# Altium schematic sheet SOC_PL_GTX.SchDoc: Title
size 420 x 297 mm; Author: G.Kasprowicz; CompanyName: WUT ISE; DrawnBy: G.Kasprowicz; Organization: WUT ISE; Address1: PW ISE; Address2: Nowowiejska 15/19 00-665 Warsaw; Address3: gkasprow@gmail.com; DocumentNumber: 17; Revision: 2; SheetNumber: 17; SheetTotal: 40; ModifiedBy: -; CheckedDate: -; Title2: Title 2; DivGrp: WUT ISE; Designer: G.Kasprowicz; ModifiedDate: -; ProjectName: Sensor Box
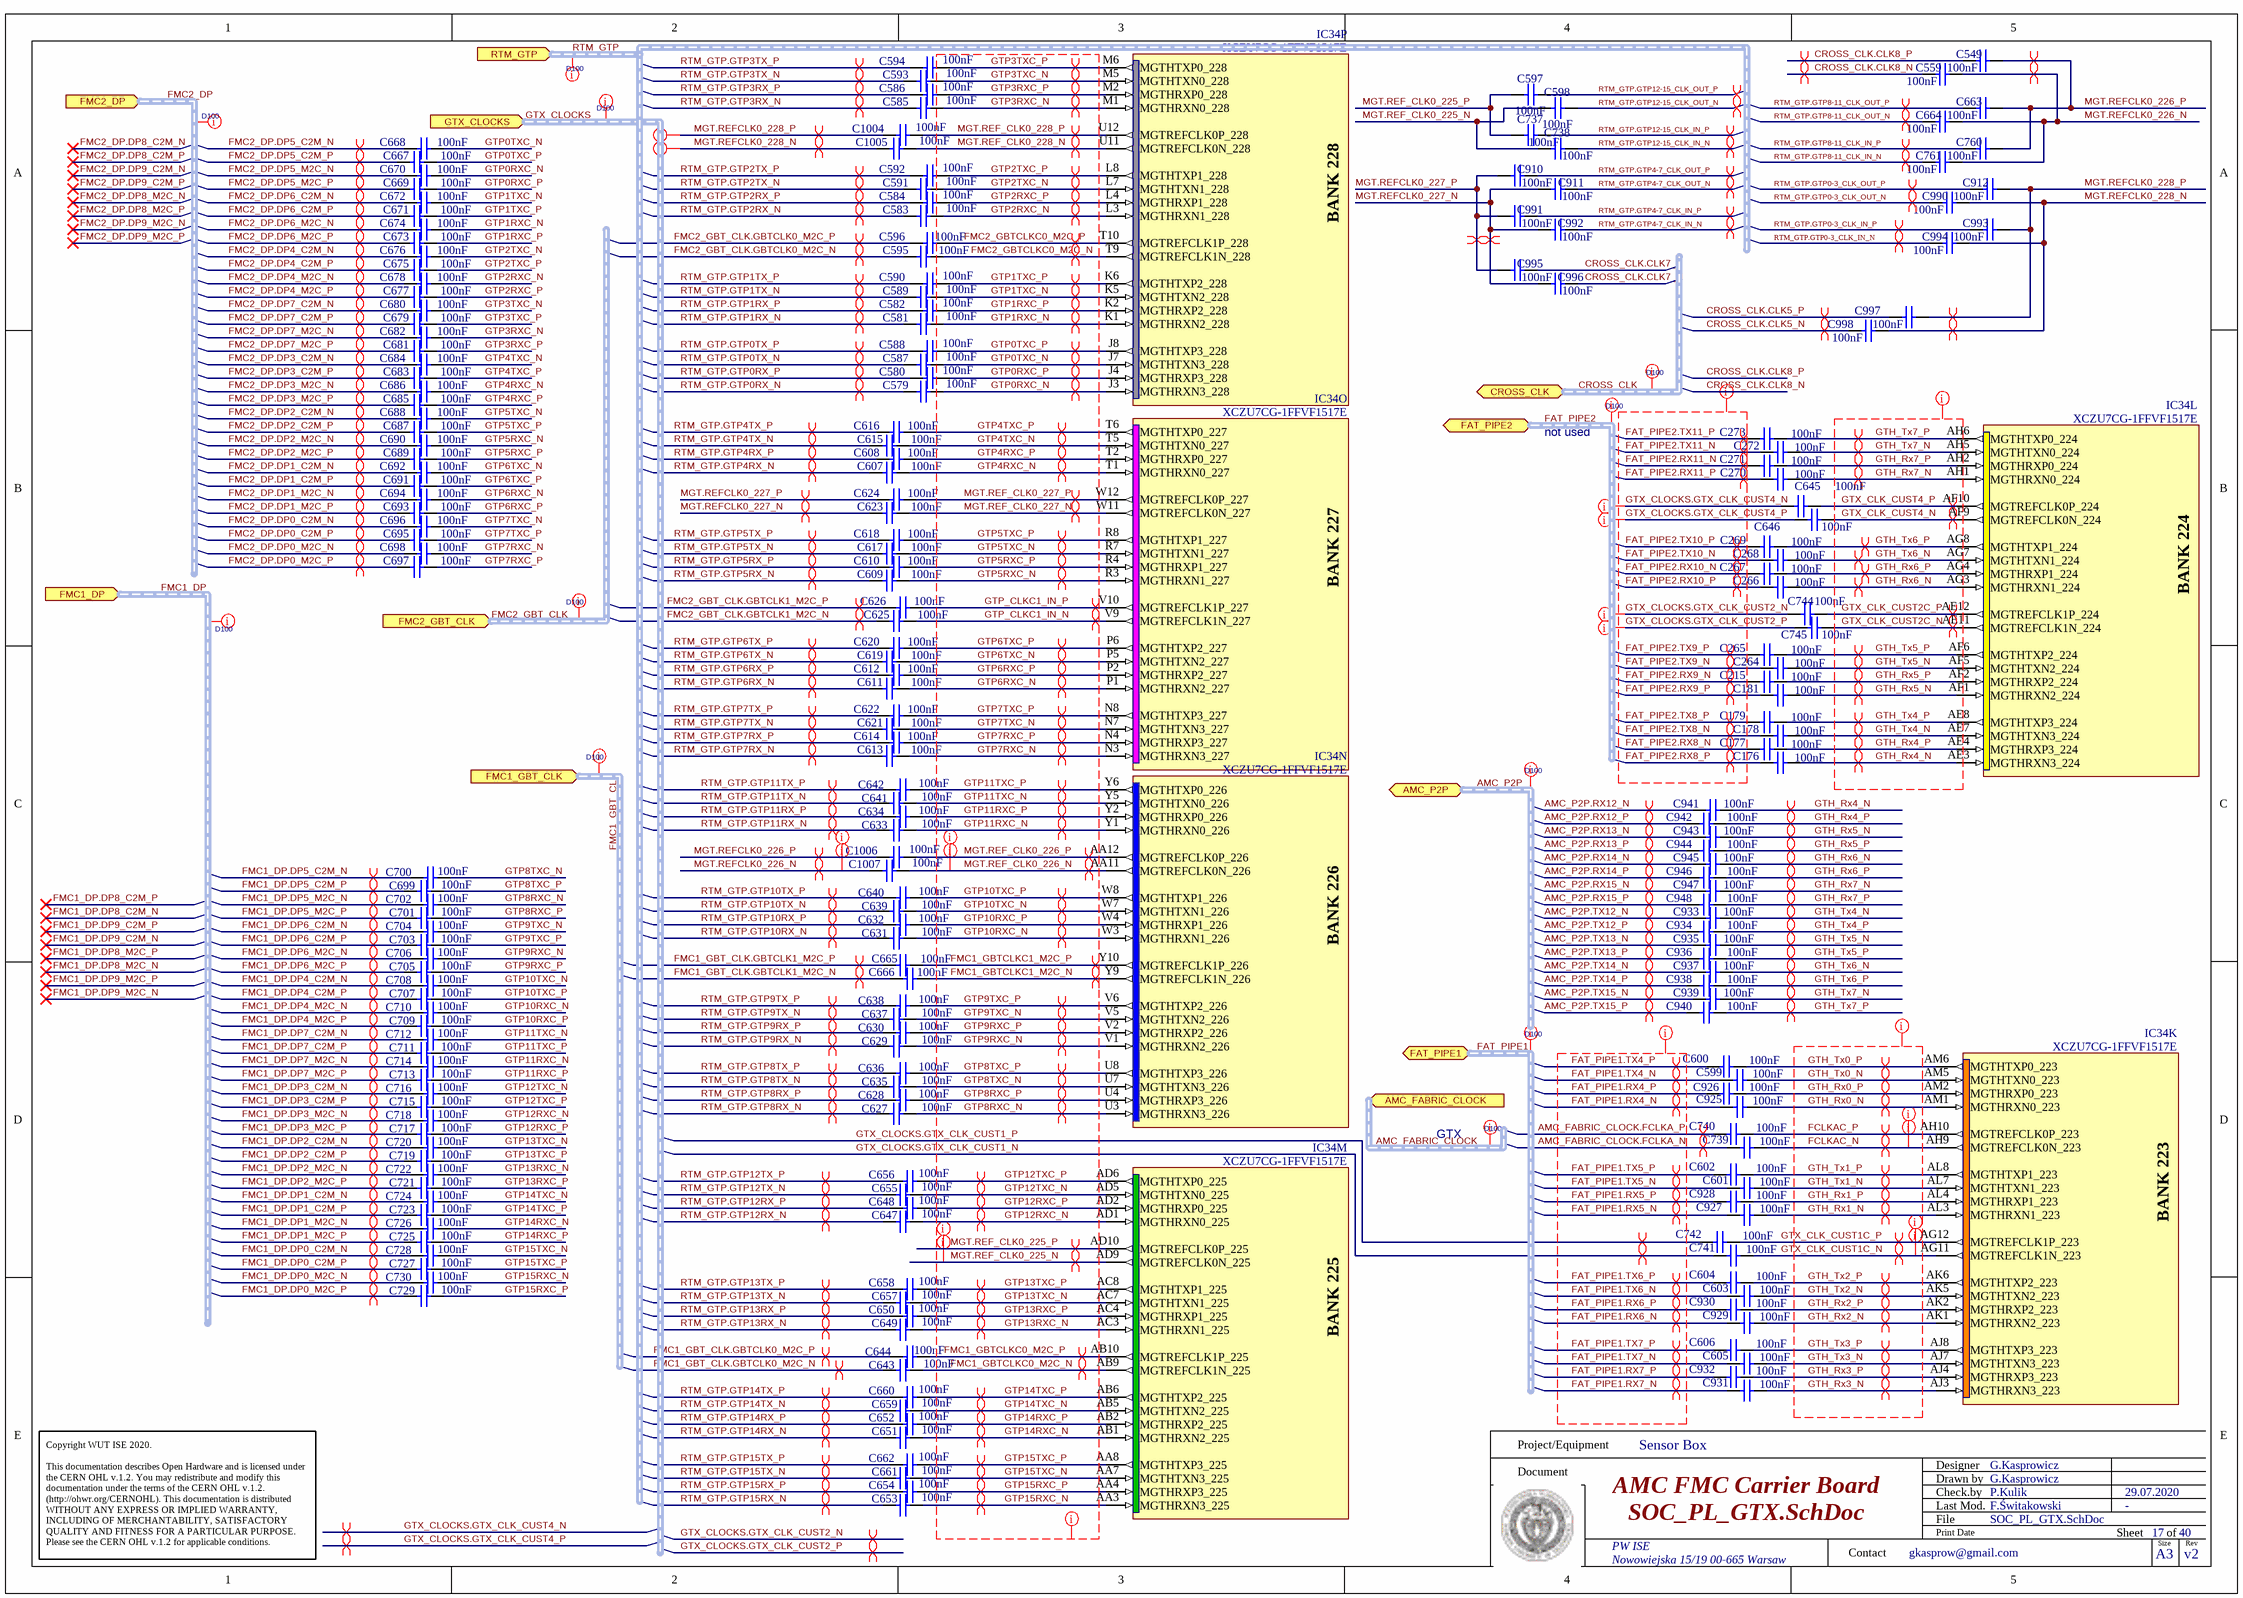
[diagram p0: SOC_PL_GTX.SchDoc]

## Parts
C176  100nF  [CAPC0603X33N]
C177  100nF  [CAPC0603X33N]
C178  100nF  [CAPC0603X33N]
C179  100nF  [CAPC0603X33N]
C181  100nF  [CAPC0603X33N]
C215  100nF  [CAPC0603X33N]
C264  100nF  [CAPC0603X33N]
C265  100nF  [CAPC0603X33N]
C266  100nF  [CAPC0603X33N]
C267  100nF  [CAPC0603X33N]
C268  100nF  [CAPC0603X33N]
C269  100nF  [CAPC0603X33N]
C270  100nF  [CAPC0603X33N]
C271  100nF  [CAPC0603X33N]
C272  100nF  [CAPC0603X33N]
C273  100nF  [CAPC0603X33N]
C549  100nF  [CAPC0603X33N]
C559  100nF  [CAPC0603X33N]
C579  100nF  [CAPC0603X33N]
C580  100nF  [CAPC0603X33N]
C581  100nF  [CAPC0603X33N]
C582  100nF  [CAPC0603X33N]
C583  100nF  [CAPC0603X33N]
C584  100nF  [CAPC0603X33N]
C585  100nF  [CAPC0603X33N]
C586  100nF  [CAPC0603X33N]
C587  100nF  [CAPC0603X33N]
C588  100nF  [CAPC0603X33N]
C589  100nF  [CAPC0603X33N]
C590  100nF  [CAPC0603X33N]
C591  100nF  [CAPC0603X33N]
C592  100nF  [CAPC0603X33N]
C593  100nF  [CAPC0603X33N]
C594  100nF  [CAPC0603X33N]
C595  100nF  [CAPC0603X33N]
C596  100nF  [CAPC0603X33N]
C597  100nF  [CAPC0603X33N]
C598  100nF  [CAPC0603X33N]
C599  100nF  [CAPC0603X33N]
C600  100nF  [CAPC0603X33N]
C601  100nF  [CAPC0603X33N]
C602  100nF  [CAPC0603X33N]
C603  100nF  [CAPC0603X33N]
C604  100nF  [CAPC0603X33N]
C605  100nF  [CAPC0603X33N]
C606  100nF  [CAPC0603X33N]
C607  100nF  [CAPC0603X33N]
C608  100nF  [CAPC0603X33N]
C609  100nF  [CAPC0603X33N]
C610  100nF  [CAPC0603X33N]
C611  100nF  [CAPC0603X33N]
C612  100nF  [CAPC0603X33N]
C613  100nF  [CAPC0603X33N]
C614  100nF  [CAPC0603X33N]
C615  100nF  [CAPC0603X33N]
C616  100nF  [CAPC0603X33N]
C617  100nF  [CAPC0603X33N]
C618  100nF  [CAPC0603X33N]
C619  100nF  [CAPC0603X33N]
C620  100nF  [CAPC0603X33N]
C621  100nF  [CAPC0603X33N]
C622  100nF  [CAPC0603X33N]
C623  100nF  [CAPC0603X33N]
C624  100nF  [CAPC0603X33N]
C625  100nF  [CAPC0603X33N]
C626  100nF  [CAPC0603X33N]
C627  100nF  [CAPC0603X33N]
C628  100nF  [CAPC0603X33N]
C629  100nF  [CAPC0603X33N]
C630  100nF  [CAPC0603X33N]
C631  100nF  [CAPC0603X33N]
C632  100nF  [CAPC0603X33N]
C633  100nF  [CAPC0603X33N]
C634  100nF  [CAPC0603X33N]
C635  100nF  [CAPC0603X33N]
C636  100nF  [CAPC0603X33N]
C637  100nF  [CAPC0603X33N]
C638  100nF  [CAPC0603X33N]
C639  100nF  [CAPC0603X33N]
C640  100nF  [CAPC0603X33N]
C641  100nF  [CAPC0603X33N]
C642  100nF  [CAPC0603X33N]
C643  100nF  [CAPC0603X33N]
C644  100nF  [CAPC0603X33N]
C645  100nF  [CAPC0603X33N]
C646  100nF  [CAPC0603X33N]
C647  100nF  [CAPC0603X33N]
C648  100nF  [CAPC0603X33N]
C649  100nF  [CAPC0603X33N]
C650  100nF  [CAPC0603X33N]
C651  100nF  [CAPC0603X33N]
C652  100nF  [CAPC0603X33N]
C653  100nF  [CAPC0603X33N]
C654  100nF  [CAPC0603X33N]
C655  100nF  [CAPC0603X33N]
C656  100nF  [CAPC0603X33N]
C657  100nF  [CAPC0603X33N]
C658  100nF  [CAPC0603X33N]
C659  100nF  [CAPC0603X33N]
C660  100nF  [CAPC0603X33N]
C661  100nF  [CAPC0603X33N]
C662  100nF  [CAPC0603X33N]
C663  100nF  [CAPC0603X33N]
C664  100nF  [CAPC0603X33N]
C665  100nF  [CAPC0603X33N]
C666  100nF  [CAPC0603X33N]
C667  100nF  [CAPC0603X33N]
C668  100nF  [CAPC0603X33N]
C669  100nF  [CAPC0603X33N]
C670  100nF  [CAPC0603X33N]
C671  100nF  [CAPC0603X33N]
C672  100nF  [CAPC0603X33N]
C673  100nF  [CAPC0603X33N]
C674  100nF  [CAPC0603X33N]
C675  100nF  [CAPC0603X33N]
C676  100nF  [CAPC0603X33N]
C677  100nF  [CAPC0603X33N]
C678  100nF  [CAPC0603X33N]
C679  100nF  [CAPC0603X33N]
C680  100nF  [CAPC0603X33N]
C681  100nF  [CAPC0603X33N]
C682  100nF  [CAPC0603X33N]
C683  100nF  [CAPC0603X33N]
C684  100nF  [CAPC0603X33N]
C685  100nF  [CAPC0603X33N]
C686  100nF  [CAPC0603X33N]
C687  100nF  [CAPC0603X33N]
C688  100nF  [CAPC0603X33N]
C689  100nF  [CAPC0603X33N]
C690  100nF  [CAPC0603X33N]
C691  100nF  [CAPC0603X33N]
C692  100nF  [CAPC0603X33N]
C693  100nF  [CAPC0603X33N]
C694  100nF  [CAPC0603X33N]
C695  100nF  [CAPC0603X33N]
C696  100nF  [CAPC0603X33N]
C697  100nF  [CAPC0603X33N]
C698  100nF  [CAPC0603X33N]
C699  100nF  [CAPC0603X33N]
C700  100nF  [CAPC0603X33N]
C701  100nF  [CAPC0603X33N]
C702  100nF  [CAPC0603X33N]
C703  100nF  [CAPC0603X33N]
C704  100nF  [CAPC0603X33N]
C705  100nF  [CAPC0603X33N]
C706  100nF  [CAPC0603X33N]
C707  100nF  [CAPC0603X33N]
C708  100nF  [CAPC0603X33N]
C709  100nF  [CAPC0603X33N]
C710  100nF  [CAPC0603X33N]
C711  100nF  [CAPC0603X33N]
C712  100nF  [CAPC0603X33N]
C713  100nF  [CAPC0603X33N]
C714  100nF  [CAPC0603X33N]
C715  100nF  [CAPC0603X33N]
C716  100nF  [CAPC0603X33N]
C717  100nF  [CAPC0603X33N]
C718  100nF  [CAPC0603X33N]
C719  100nF  [CAPC0603X33N]
C720  100nF  [CAPC0603X33N]
C721  100nF  [CAPC0603X33N]
C722  100nF  [CAPC0603X33N]
C723  100nF  [CAPC0603X33N]
C724  100nF  [CAPC0603X33N]
C725  100nF  [CAPC0603X33N]
C726  100nF  [CAPC0603X33N]
C727  100nF  [CAPC0603X33N]
C728  100nF  [CAPC0603X33N]
C729  100nF  [CAPC0603X33N]
C730  100nF  [CAPC0603X33N]
C737  100nF  [CAPC0603X33N]
C738  100nF  [CAPC0603X33N]
C739  100nF  [CAPC0603X33N]
C740  100nF  [CAPC0603X33N]
C741  100nF  [CAPC0603X33N]
C742  100nF  [CAPC0603X33N]
C744  100nF  [CAPC0603X33N]
C745  100nF  [CAPC0603X33N]
C760  100nF  [CAPC0603X33N]
C761  100nF  [CAPC0603X33N]
C910  100nF  [CAPC0603X33N]
C911  100nF  [CAPC0603X33N]
C912  100nF  [CAPC0603X33N]
C925  100nF  [CAPC0603X33N]
C926  100nF  [CAPC0603X33N]
C927  100nF  [CAPC0603X33N]
C928  100nF  [CAPC0603X33N]
C929  100nF  [CAPC0603X33N]
C930  100nF  [CAPC0603X33N]
C931  100nF  [CAPC0603X33N]
C932  100nF  [CAPC0603X33N]
C933  100nF  [CAPC0603X33N]
C934  100nF  [CAPC0603X33N]
C935  100nF  [CAPC0603X33N]
C936  100nF  [CAPC0603X33N]
C937  100nF  [CAPC0603X33N]
C938  100nF  [CAPC0603X33N]
C939  100nF  [CAPC0603X33N]
C940  100nF  [CAPC0603X33N]
C941  100nF  [CAPC0603X33N]
C942  100nF  [CAPC0603X33N]
C943  100nF  [CAPC0603X33N]
C944  100nF  [CAPC0603X33N]
C945  100nF  [CAPC0603X33N]
C946  100nF  [CAPC0603X33N]
C947  100nF  [CAPC0603X33N]
C948  100nF  [CAPC0603X33N]
C990  100nF  [CAPC0603X33N]
C991  100nF  [CAPC0603X33N]
C992  100nF  [CAPC0603X33N]
C993  100nF  [CAPC0603X33N]
C994  100nF  [CAPC0603X33N]
C995  100nF  [CAPC0603X33N]
C996  100nF  [CAPC0603X33N]
C997  100nF  [CAPC0603X33N]
C998  100nF  [CAPC0603X33N]
C1004  100nF  [CAPC0603X33N]
C1005  100nF  [CAPC0603X33N]
C1006  100nF  [CAPC0603X33N]
C1007  100nF  [CAPC0603X33N]
IC34  XCZU7CG-1FFVF1517E  [BGA1517C100P39X39_4000X4000X351]  (parts K,L,M,N,O,P of 28)

## Ports
AMC_FABRIC_CLOCK (in, harness AMC_FABRIC_CLOCK), AMC_P2P (bidir, harness AMC_P2P), CROSS_CLK (bidir, harness CROSS_CLK), FAT_PIPE1 (bidir, harness FAT_PIPE1), FAT_PIPE2 (bidir, harness FAT_PIPE2), FMC1_DP (in, harness FMC1_DP), FMC1_GBT_CLK (in, harness FMC1_GBT_CLK), FMC2_DP (in, harness FMC2_DP), FMC2_GBT_CLK (in, harness FMC2_GBT_CLK), GTX_CLOCKS (in, harness GTX_CLOCKS), RTM_GTP (in, harness RTM_GTP)

## Nets
AMC_FABRIC_CLOCK.FCLKA_N: C739.1
AMC_FABRIC_CLOCK.FCLKA_P: C740.1
AMC_P2P.RX12_N: C941.1
AMC_P2P.RX12_P: C942.1
AMC_P2P.RX13_N: C943.1
AMC_P2P.RX13_P: C944.1
AMC_P2P.RX14_N: C945.1
AMC_P2P.RX14_P: C946.1
AMC_P2P.RX15_N: C947.1
AMC_P2P.RX15_P: C948.1
AMC_P2P.TX12_N: C933.1
AMC_P2P.TX12_P: C934.1
AMC_P2P.TX13_N: C935.1
AMC_P2P.TX13_P: C936.1
AMC_P2P.TX14_N: C937.1
AMC_P2P.TX14_P: C938.1
AMC_P2P.TX15_N: C939.1
AMC_P2P.TX15_P: C940.1
CROSS_CLK.CLK5_N: C998.2
CROSS_CLK.CLK5_P: C997.2
CROSS_CLK.CLK7_N: C996.2
CROSS_CLK.CLK7_P: C995.2
CROSS_CLK.CLK8_N: C559.2
CROSS_CLK.CLK8_P: C549.2
FAT_PIPE1.RX4_N: C925.1
FAT_PIPE1.RX4_P: C926.1
FAT_PIPE1.RX5_N: C927.1
FAT_PIPE1.RX5_P: C928.1
FAT_PIPE1.RX6_N: C929.1
FAT_PIPE1.RX6_P: C930.1
FAT_PIPE1.RX7_N: C931.1
FAT_PIPE1.RX7_P: C932.1
FAT_PIPE1.TX4_N: C599.1
FAT_PIPE1.TX4_P: C600.1
FAT_PIPE1.TX5_N: C601.1
FAT_PIPE1.TX5_P: C602.1
FAT_PIPE1.TX6_N: C603.1
FAT_PIPE1.TX6_P: C604.1
FAT_PIPE1.TX7_N: C605.1
FAT_PIPE1.TX7_P: C606.1
FAT_PIPE2.RX8_N: C177.1
FAT_PIPE2.RX8_P: C176.1
FAT_PIPE2.RX9_N: C215.1
FAT_PIPE2.RX9_P: C181.1
FAT_PIPE2.RX10_N: C267.1
FAT_PIPE2.RX10_P: C266.1
FAT_PIPE2.RX11_N: C271.1
FAT_PIPE2.RX11_P: C270.1
FAT_PIPE2.TX8_N: C178.1
FAT_PIPE2.TX8_P: C179.1
FAT_PIPE2.TX9_N: C264.1
FAT_PIPE2.TX9_P: C265.1
FAT_PIPE2.TX10_N: C268.1
FAT_PIPE2.TX10_P: C269.1
FAT_PIPE2.TX11_N: C272.1
FAT_PIPE2.TX11_P: C273.1
FCLKAC_N: C739.2 IC34.AH9(MGTREFCLK0N_223)
FCLKAC_P: C740.2 IC34.AH10(MGTREFCLK0P_223)
FMC1_DP.DP0_C2M_N: C728.1
FMC1_DP.DP0_C2M_P: C727.1
FMC1_DP.DP0_M2C_N: C730.1
FMC1_DP.DP0_M2C_P: C729.1
FMC1_DP.DP1_C2M_N: C724.1
FMC1_DP.DP1_C2M_P: C723.1
FMC1_DP.DP1_M2C_N: C726.1
FMC1_DP.DP1_M2C_P: C725.1
FMC1_DP.DP2_C2M_N: C720.1
FMC1_DP.DP2_C2M_P: C719.1
FMC1_DP.DP2_M2C_N: C722.1
FMC1_DP.DP2_M2C_P: C721.1
FMC1_DP.DP3_C2M_N: C716.1
FMC1_DP.DP3_C2M_P: C715.1
FMC1_DP.DP3_M2C_N: C718.1
FMC1_DP.DP3_M2C_P: C717.1
FMC1_DP.DP4_C2M_N: C708.1
FMC1_DP.DP4_C2M_P: C707.1
FMC1_DP.DP4_M2C_N: C710.1
FMC1_DP.DP4_M2C_P: C709.1
FMC1_DP.DP5_C2M_N: C700.1
FMC1_DP.DP5_C2M_P: C699.1
FMC1_DP.DP5_M2C_N: C702.1
FMC1_DP.DP5_M2C_P: C701.1
FMC1_DP.DP6_C2M_N: C704.1
FMC1_DP.DP6_C2M_P: C703.1
FMC1_DP.DP6_M2C_N: C706.1
FMC1_DP.DP6_M2C_P: C705.1
FMC1_DP.DP7_C2M_N: C712.1
FMC1_DP.DP7_C2M_P: C711.1
FMC1_DP.DP7_M2C_N: C714.1
FMC1_DP.DP7_M2C_P: C713.1
FMC1_GBT_CLK.GBTCLK0_M2C_N: C643.1
FMC1_GBT_CLK.GBTCLK0_M2C_P: C644.1
FMC1_GBT_CLK.GBTCLK1_M2C_N: C666.1
FMC1_GBT_CLK.GBTCLK1_M2C_P: C665.1
FMC1_GBTCLKC0_M2C_N: C643.2 IC34.AB9(MGTREFCLK1N_225)
FMC1_GBTCLKC0_M2C_P: C644.2 IC34.AB10(MGTREFCLK1P_225)
FMC1_GBTCLKC1_M2C_N: C666.2 IC34.Y9(MGTREFCLK1N_226)
FMC1_GBTCLKC1_M2C_P: C665.2 IC34.Y10(MGTREFCLK1P_226)
FMC2_DP.DP0_C2M_N: C696.1
FMC2_DP.DP0_C2M_P: C695.1
FMC2_DP.DP0_M2C_N: C698.1
FMC2_DP.DP0_M2C_P: C697.1
FMC2_DP.DP1_C2M_N: C692.1
FMC2_DP.DP1_C2M_P: C691.1
FMC2_DP.DP1_M2C_N: C694.1
FMC2_DP.DP1_M2C_P: C693.1
FMC2_DP.DP2_C2M_N: C688.1
FMC2_DP.DP2_C2M_P: C687.1
FMC2_DP.DP2_M2C_N: C690.1
FMC2_DP.DP2_M2C_P: C689.1
FMC2_DP.DP3_C2M_N: C684.1
FMC2_DP.DP3_C2M_P: C683.1
FMC2_DP.DP3_M2C_N: C686.1
FMC2_DP.DP3_M2C_P: C685.1
FMC2_DP.DP4_C2M_N: C676.1
FMC2_DP.DP4_C2M_P: C675.1
FMC2_DP.DP4_M2C_N: C678.1
FMC2_DP.DP4_M2C_P: C677.1
FMC2_DP.DP5_C2M_N: C668.1
FMC2_DP.DP5_C2M_P: C667.1
FMC2_DP.DP5_M2C_N: C670.1
FMC2_DP.DP5_M2C_P: C669.1
FMC2_DP.DP6_C2M_N: C672.1
FMC2_DP.DP6_C2M_P: C671.1
FMC2_DP.DP6_M2C_N: C674.1
FMC2_DP.DP6_M2C_P: C673.1
FMC2_DP.DP7_C2M_N: C680.1
FMC2_DP.DP7_C2M_P: C679.1
FMC2_DP.DP7_M2C_N: C682.1
FMC2_DP.DP7_M2C_P: C681.1
FMC2_GBT_CLK.GBTCLK0_M2C_N: C595.1
FMC2_GBT_CLK.GBTCLK0_M2C_P: C596.1
FMC2_GBT_CLK.GBTCLK1_M2C_N: C625.1
FMC2_GBT_CLK.GBTCLK1_M2C_P: C626.1
FMC2_GBTCLKC0_M2C_N: C595.2 IC34.T9(MGTREFCLK1N_228)
FMC2_GBTCLKC0_M2C_P: C596.2 IC34.T10(MGTREFCLK1P_228)
GTH_Rx0_N: C925.2 IC34.AM1(MGTHRXN0_223)
GTH_Rx0_P: C926.2 IC34.AM2(MGTHRXP0_223)
GTH_Rx1_N: C927.2 IC34.AL3(MGTHRXN1_223)
GTH_Rx1_P: C928.2 IC34.AL4(MGTHRXP1_223)
GTH_Rx2_N: C929.2 IC34.AK1(MGTHRXN2_223)
GTH_Rx2_P: C930.2 IC34.AK2(MGTHRXP2_223)
GTH_Rx3_N: C931.2 IC34.AJ3(MGTHRXN3_223)
GTH_Rx3_P: C932.2 IC34.AJ4(MGTHRXP3_223)
GTH_Rx4_N: C176.2 C941.2 IC34.AE3(MGTHRXN3_224)
GTH_Rx4_P: C177.2 C942.2 IC34.AE4(MGTHRXP3_224)
GTH_Rx5_N: C181.2 C943.2 IC34.AF1(MGTHRXN2_224)
GTH_Rx5_P: C215.2 C944.2 IC34.AF2(MGTHRXP2_224)
GTH_Rx6_N: C266.2 C945.2 IC34.AG3(MGTHRXN1_224)
GTH_Rx6_P: C267.2 C946.2 IC34.AG4(MGTHRXP1_224)
GTH_Rx7_N: C270.2 C947.2 IC34.AH1(MGTHRXN0_224)
GTH_Rx7_P: C271.2 C948.2 IC34.AH2(MGTHRXP0_224)
GTH_Tx0_N: C599.2 IC34.AM5(MGTHTXN0_223)
GTH_Tx0_P: C600.2 IC34.AM6(MGTHTXP0_223)
GTH_Tx1_N: C601.2 IC34.AL7(MGTHTXN1_223)
GTH_Tx1_P: C602.2 IC34.AL8(MGTHTXP1_223)
GTH_Tx2_N: C603.2 IC34.AK5(MGTHTXN2_223)
GTH_Tx2_P: C604.2 IC34.AK6(MGTHTXP2_223)
GTH_Tx3_N: C605.2 IC34.AJ7(MGTHTXN3_223)
GTH_Tx3_P: C606.2 IC34.AJ8(MGTHTXP3_223)
GTH_Tx4_N: C178.2 C933.2 IC34.AE7(MGTHTXN3_224)
GTH_Tx4_P: C179.2 C934.2 IC34.AE8(MGTHTXP3_224)
GTH_Tx5_N: C264.2 C935.2 IC34.AF5(MGTHTXN2_224)
GTH_Tx5_P: C265.2 C936.2 IC34.AF6(MGTHTXP2_224)
GTH_Tx6_N: C268.2 C937.2 IC34.AG7(MGTHTXN1_224)
GTH_Tx6_P: C269.2 C938.2 IC34.AG8(MGTHTXP1_224)
GTH_Tx7_N: C272.2 C939.2 IC34.AH5(MGTHTXN0_224)
GTH_Tx7_P: C273.2 C940.2 IC34.AH6(MGTHTXP0_224)
GTP0RXC_N: C579.2 C670.2 IC34.J3(MGTHRXN3_228)
GTP0RXC_P: C580.2 C669.2 IC34.J4(MGTHRXP3_228)
GTP0TXC_N: C587.2 C668.2 IC34.J7(MGTHTXN3_228)
GTP0TXC_P: C588.2 C667.2 IC34.J8(MGTHTXP3_228)
GTP1RXC_N: C581.2 C674.2 IC34.K1(MGTHRXN2_228)
GTP1RXC_P: C582.2 C673.2 IC34.K2(MGTHRXP2_228)
GTP1TXC_N: C589.2 C672.2 IC34.K5(MGTHTXN2_228)
GTP1TXC_P: C590.2 C671.2 IC34.K6(MGTHTXP2_228)
GTP2RXC_N: C583.2 C678.2 IC34.L3(MGTHRXN1_228)
GTP2RXC_P: C584.2 C677.2 IC34.L4(MGTHRXP1_228)
GTP2TXC_N: C591.2 C676.2 IC34.L7(MGTHTXN1_228)
GTP2TXC_P: C592.2 C675.2 IC34.L8(MGTHTXP1_228)
GTP3RXC_N: C585.2 C682.2 IC34.M1(MGTHRXN0_228)
GTP3RXC_P: C586.2 C681.2 IC34.M2(MGTHRXP0_228)
GTP3TXC_N: C593.2 C680.2 IC34.M5(MGTHTXN0_228)
GTP3TXC_P: C594.2 C679.2 IC34.M6(MGTHTXP0_228)
GTP4RXC_N: C607.2 C686.2 IC34.T1(MGTHRXN0_227)
GTP4RXC_P: C608.2 C685.2 IC34.T2(MGTHRXP0_227)
GTP4TXC_N: C615.2 C684.2 IC34.T5(MGTHTXN0_227)
GTP4TXC_P: C616.2 C683.2 IC34.T6(MGTHTXP0_227)
GTP5RXC_N: C609.2 C690.2 IC34.R3(MGTHRXN1_227)
GTP5RXC_P: C610.2 C689.2 IC34.R4(MGTHRXP1_227)
GTP5TXC_N: C617.2 C688.2 IC34.R7(MGTHTXN1_227)
GTP5TXC_P: C618.2 C687.2 IC34.R8(MGTHTXP1_227)
GTP6RXC_N: C611.2 C694.2 IC34.P1(MGTHRXN2_227)
GTP6RXC_P: C612.2 C693.2 IC34.P2(MGTHRXP2_227)
GTP6TXC_N: C619.2 C692.2 IC34.P5(MGTHTXN2_227)
GTP6TXC_P: C620.2 C691.2 IC34.P6(MGTHTXP2_227)
GTP7RXC_N: C613.2 C698.2 IC34.N3(MGTHRXN3_227)
GTP7RXC_P: C614.2 C697.2 IC34.N4(MGTHRXP3_227)
GTP7TXC_N: C621.2 C696.2 IC34.N7(MGTHTXN3_227)
GTP7TXC_P: C622.2 C695.2 IC34.N8(MGTHTXP3_227)
GTP8RXC_N: C627.2 C702.2 IC34.U3(MGTHRXN3_226)
GTP8RXC_P: C628.2 C701.2 IC34.U4(MGTHRXP3_226)
GTP8TXC_N: C635.2 C700.2 IC34.U7(MGTHTXN3_226)
GTP8TXC_P: C636.2 C699.2 IC34.U8(MGTHTXP3_226)
GTP9RXC_N: C629.2 C706.2 IC34.V1(MGTHRXN2_226)
GTP9RXC_P: C630.2 C705.2 IC34.V2(MGTHRXP2_226)
GTP9TXC_N: C637.2 C704.2 IC34.V5(MGTHTXN2_226)
GTP9TXC_P: C638.2 C703.2 IC34.V6(MGTHTXP2_226)
GTP10RXC_N: C631.2 C710.2 IC34.W3(MGTHRXN1_226)
GTP10RXC_P: C632.2 C709.2 IC34.W4(MGTHRXP1_226)
GTP10TXC_N: C639.2 C708.2 IC34.W7(MGTHTXN1_226)
GTP10TXC_P: C640.2 C707.2 IC34.W8(MGTHTXP1_226)
GTP11RXC_N: C633.2 C714.2 IC34.Y1(MGTHRXN0_226)
GTP11RXC_P: C634.2 C713.2 IC34.Y2(MGTHRXP0_226)
GTP11TXC_N: C641.2 C712.2 IC34.Y5(MGTHTXN0_226)
GTP11TXC_P: C642.2 C711.2 IC34.Y6(MGTHTXP0_226)
GTP12RXC_N: C647.2 C718.2 IC34.AD1(MGTHRXN0_225)
GTP12RXC_P: C648.2 C717.2 IC34.AD2(MGTHRXP0_225)
GTP12TXC_N: C655.2 C716.2 IC34.AD5(MGTHTXN0_225)
GTP12TXC_P: C656.2 C715.2 IC34.AD6(MGTHTXP0_225)
GTP13RXC_N: C649.2 C722.2 IC34.AC3(MGTHRXN1_225)
GTP13RXC_P: C650.2 C721.2 IC34.AC4(MGTHRXP1_225)
GTP13TXC_N: C657.2 C720.2 IC34.AC7(MGTHTXN1_225)
GTP13TXC_P: C658.2 C719.2 IC34.AC8(MGTHTXP1_225)
GTP14RXC_N: C651.2 C726.2 IC34.AB1(MGTHRXN2_225)
GTP14RXC_P: C652.2 C725.2 IC34.AB2(MGTHRXP2_225)
GTP14TXC_N: C659.2 C724.2 IC34.AB5(MGTHTXN2_225)
GTP14TXC_P: C660.2 C723.2 IC34.AB6(MGTHTXP2_225)
GTP15RXC_N: C653.2 C730.2 IC34.AA3(MGTHRXN3_225)
GTP15RXC_P: C654.2 C729.2 IC34.AA4(MGTHRXP3_225)
GTP15TXC_N: C661.2 C728.2 IC34.AA7(MGTHTXN3_225)
GTP15TXC_P: C662.2 C727.2 IC34.AA8(MGTHTXP3_225)
GTP_CLKC1_IN_N: C625.2 IC34.V9(MGTREFCLK1N_227)
GTP_CLKC1_IN_P: C626.2 IC34.V10(MGTREFCLK1P_227)
GTX_CLK_CUST1C_N: C741.2 IC34.AG11(MGTREFCLK1N_223)
GTX_CLK_CUST1C_P: C742.2 IC34.AG12(MGTREFCLK1P_223)
GTX_CLK_CUST2C_N: C745.2 IC34.AE11(MGTREFCLK1N_224)
GTX_CLK_CUST2C_P: C744.2 IC34.AE12(MGTREFCLK1P_224)
GTX_CLK_CUST4_N: C646.2 IC34.AF9(MGTREFCLK0N_224)
GTX_CLK_CUST4_P: C645.2 IC34.AF10(MGTREFCLK0P_224)
GTX_CLOCKS.GTX_CLK_CUST1_N: C741.1
GTX_CLOCKS.GTX_CLK_CUST1_P: C742.1
GTX_CLOCKS.GTX_CLK_CUST2_N: C744.1
GTX_CLOCKS.GTX_CLK_CUST2_P: C745.1
GTX_CLOCKS.GTX_CLK_CUST4_N: C645.1
GTX_CLOCKS.GTX_CLK_CUST4_P: C646.1
MGT.REF_CLK0_225_N: C598.1 C738.1 IC34.AD9(MGTREFCLK0N_225)
MGT.REF_CLK0_225_P: C597.1 C737.1 IC34.AD10(MGTREFCLK0P_225)
MGT.REF_CLK0_226_N: C1007.2 IC34.AA11(MGTREFCLK0N_226)
MGT.REF_CLK0_226_P: C1006.2 IC34.AA12(MGTREFCLK0P_226)
MGT.REF_CLK0_227_N: C623.2 IC34.W11(MGTREFCLK0N_227)
MGT.REF_CLK0_227_P: C624.2 IC34.W12(MGTREFCLK0P_227)
MGT.REF_CLK0_228_N: C1005.2 IC34.U11(MGTREFCLK0N_228)
MGT.REF_CLK0_228_P: C1004.2 IC34.U12(MGTREFCLK0P_228)
MGT.REFCLK0_226_N: C559.1 C664.1 C761.1 C1007.1
MGT.REFCLK0_226_P: C549.1 C663.1 C760.1 C1006.1
MGT.REFCLK0_227_N: C623.1 C911.1 C992.1 C996.1
MGT.REFCLK0_227_P: C624.1 C910.1 C991.1 C995.1
MGT.REFCLK0_228_N: C990.1 C994.1 C998.1 C1005.1
MGT.REFCLK0_228_P: C912.1 C993.1 C997.1 C1004.1
RTM_GTP.GTP0-3_CLK_IN_N: C994.2
RTM_GTP.GTP0-3_CLK_IN_P: C993.2
RTM_GTP.GTP0-3_CLK_OUT_N: C990.2
RTM_GTP.GTP0-3_CLK_OUT_P: C912.2
RTM_GTP.GTP0RX_N: C579.1
RTM_GTP.GTP0RX_P: C580.1
RTM_GTP.GTP0TX_N: C587.1
RTM_GTP.GTP0TX_P: C588.1
RTM_GTP.GTP1RX_N: C581.1
RTM_GTP.GTP1RX_P: C582.1
RTM_GTP.GTP1TX_N: C589.1
RTM_GTP.GTP1TX_P: C590.1
RTM_GTP.GTP2RX_N: C583.1
RTM_GTP.GTP2RX_P: C584.1
RTM_GTP.GTP2TX_N: C591.1
RTM_GTP.GTP2TX_P: C592.1
RTM_GTP.GTP3RX_N: C585.1
RTM_GTP.GTP3RX_P: C586.1
RTM_GTP.GTP3TX_N: C593.1
RTM_GTP.GTP3TX_P: C594.1
RTM_GTP.GTP4-7_CLK_IN_N: C992.2
RTM_GTP.GTP4-7_CLK_IN_P: C991.2
RTM_GTP.GTP4-7_CLK_OUT_N: C911.2
RTM_GTP.GTP4-7_CLK_OUT_P: C910.2
RTM_GTP.GTP4RX_N: C607.1
RTM_GTP.GTP4RX_P: C608.1
RTM_GTP.GTP4TX_N: C615.1
RTM_GTP.GTP4TX_P: C616.1
RTM_GTP.GTP5RX_N: C609.1
RTM_GTP.GTP5RX_P: C610.1
RTM_GTP.GTP5TX_N: C617.1
RTM_GTP.GTP5TX_P: C618.1
RTM_GTP.GTP6RX_N: C611.1
RTM_GTP.GTP6RX_P: C612.1
RTM_GTP.GTP6TX_N: C619.1
RTM_GTP.GTP6TX_P: C620.1
RTM_GTP.GTP7RX_N: C613.1
RTM_GTP.GTP7RX_P: C614.1
RTM_GTP.GTP7TX_N: C621.1
RTM_GTP.GTP7TX_P: C622.1
RTM_GTP.GTP8-11_CLK_IN_N: C761.2
RTM_GTP.GTP8-11_CLK_IN_P: C760.2
RTM_GTP.GTP8-11_CLK_OUT_N: C664.2
RTM_GTP.GTP8-11_CLK_OUT_P: C663.2
RTM_GTP.GTP8RX_N: C627.1
RTM_GTP.GTP8RX_P: C628.1
RTM_GTP.GTP8TX_N: C635.1
RTM_GTP.GTP8TX_P: C636.1
RTM_GTP.GTP9RX_N: C629.1
RTM_GTP.GTP9RX_P: C630.1
RTM_GTP.GTP9TX_N: C637.1
RTM_GTP.GTP9TX_P: C638.1
RTM_GTP.GTP10RX_N: C631.1
RTM_GTP.GTP10RX_P: C632.1
RTM_GTP.GTP10TX_N: C639.1
RTM_GTP.GTP10TX_P: C640.1
RTM_GTP.GTP11RX_N: C633.1
RTM_GTP.GTP11RX_P: C634.1
RTM_GTP.GTP11TX_N: C641.1
RTM_GTP.GTP11TX_P: C642.1
RTM_GTP.GTP12-15_CLK_IN_N: C738.2
RTM_GTP.GTP12-15_CLK_IN_P: C737.2
RTM_GTP.GTP12-15_CLK_OUT_N: C598.2
RTM_GTP.GTP12-15_CLK_OUT_P: C597.2
RTM_GTP.GTP12RX_N: C647.1
RTM_GTP.GTP12RX_P: C648.1
RTM_GTP.GTP12TX_N: C655.1
RTM_GTP.GTP12TX_P: C656.1
RTM_GTP.GTP13RX_N: C649.1
RTM_GTP.GTP13RX_P: C650.1
RTM_GTP.GTP13TX_N: C657.1
RTM_GTP.GTP13TX_P: C658.1
RTM_GTP.GTP14RX_N: C651.1
RTM_GTP.GTP14RX_P: C652.1
RTM_GTP.GTP14TX_N: C659.1
RTM_GTP.GTP14TX_P: C660.1
RTM_GTP.GTP15RX_N: C653.1
RTM_GTP.GTP15RX_P: C654.1
RTM_GTP.GTP15TX_N: C661.1
RTM_GTP.GTP15TX_P: C662.1

## Buses and harness runs
harness AMC_FABRIC_CLOCK = port AMC_FABRIC_CLOCK
harness AMC_P2P = port AMC_P2P
harness CROSS_CLK = port CROSS_CLK
harness FAT_PIPE1 = port FAT_PIPE1
harness FAT_PIPE2 = port FAT_PIPE2
harness FMC1_DP = port FMC1_DP
harness FMC1_GBT_CLK = port FMC1_GBT_CLK
harness FMC2_DP = port FMC2_DP
harness FMC2_GBT_CLK = port FMC2_GBT_CLK
harness GTX_CLOCKS = port GTX_CLOCKS
harness RTM_GTP = port RTM_GTP

## Layout directives
differential pair: AMC_FABRIC_CLOCK.FCLKA_N, AMC_FABRIC_CLOCK.FCLKA_P, AMC_P2P.RX12_N, AMC_P2P.RX12_P, AMC_P2P.RX13_N, AMC_P2P.RX13_P, AMC_P2P.RX14_N, AMC_P2P.RX14_P, AMC_P2P.RX15_N, AMC_P2P.RX15_P, AMC_P2P.TX12_N, AMC_P2P.TX12_P, AMC_P2P.TX13_N, AMC_P2P.TX13_P, AMC_P2P.TX14_N, AMC_P2P.TX14_P, AMC_P2P.TX15_N, AMC_P2P.TX15_P, CROSS_CLK.CLK5_N, CROSS_CLK.CLK5_P, CROSS_CLK.CLK8_N, CROSS_CLK.CLK8_P, FAT_PIPE1.RX4_N, FAT_PIPE1.RX4_P, FAT_PIPE1.RX5_N, FAT_PIPE1.RX5_P, FAT_PIPE1.RX6_N, FAT_PIPE1.RX6_P, FAT_PIPE1.RX7_N, FAT_PIPE1.RX7_P, FAT_PIPE1.TX4_N, FAT_PIPE1.TX4_P, FAT_PIPE1.TX5_N, FAT_PIPE1.TX5_P, FAT_PIPE1.TX6_N, FAT_PIPE1.TX6_P, FAT_PIPE1.TX7_N, FAT_PIPE1.TX7_P, FAT_PIPE2.RX8_N, FAT_PIPE2.RX8_P, FAT_PIPE2.RX9_N, FAT_PIPE2.RX9_P, FAT_PIPE2.RX10_N, FAT_PIPE2.RX10_P, FAT_PIPE2.RX11_N, FAT_PIPE2.RX11_P, FAT_PIPE2.TX8_N, FAT_PIPE2.TX8_P, FAT_PIPE2.TX9_N, FAT_PIPE2.TX9_P, FAT_PIPE2.TX10_N, FAT_PIPE2.TX10_P, FAT_PIPE2.TX11_N, FAT_PIPE2.TX11_P, FCLKAC_N, FCLKAC_P, FMC1_DP.DP0_C2M_N, FMC1_DP.DP0_C2M_P, FMC1_DP.DP0_M2C_N, FMC1_DP.DP0_M2C_P, FMC1_DP.DP1_C2M_N, FMC1_DP.DP1_C2M_P, FMC1_DP.DP1_M2C_N, FMC1_DP.DP1_M2C_P, FMC1_DP.DP2_C2M_N, FMC1_DP.DP2_C2M_P, FMC1_DP.DP2_M2C_N, FMC1_DP.DP2_M2C_P, FMC1_DP.DP3_C2M_N, FMC1_DP.DP3_C2M_P, FMC1_DP.DP3_M2C_N, FMC1_DP.DP3_M2C_P, FMC1_DP.DP4_C2M_N, FMC1_DP.DP4_C2M_P, FMC1_DP.DP4_M2C_N, FMC1_DP.DP4_M2C_P, FMC1_DP.DP5_C2M_N, FMC1_DP.DP5_C2M_P, FMC1_DP.DP5_M2C_N, FMC1_DP.DP5_M2C_P, FMC1_DP.DP6_C2M_N, FMC1_DP.DP6_C2M_P, FMC1_DP.DP6_M2C_N, FMC1_DP.DP6_M2C_P, FMC1_DP.DP7_C2M_N, FMC1_DP.DP7_C2M_P, FMC1_DP.DP7_M2C_N, FMC1_DP.DP7_M2C_P, FMC1_GBT_CLK.GBTCLK0_M2C_N, FMC1_GBT_CLK.GBTCLK0_M2C_P, FMC1_GBT_CLK.GBTCLK1_M2C_N, FMC1_GBT_CLK.GBTCLK1_M2C_P, FMC1_GBTCLKC0_M2C_N, FMC1_GBTCLKC0_M2C_P, FMC1_GBTCLKC1_M2C_N, FMC1_GBTCLKC1_M2C_P, FMC2_DP.DP0_C2M_N, FMC2_DP.DP0_C2M_P, FMC2_DP.DP0_M2C_N, FMC2_DP.DP0_M2C_P, FMC2_DP.DP1_C2M_N, FMC2_DP.DP1_C2M_P, FMC2_DP.DP1_M2C_N, FMC2_DP.DP1_M2C_P, FMC2_DP.DP2_C2M_N, FMC2_DP.DP2_C2M_P, FMC2_DP.DP2_M2C_N, FMC2_DP.DP2_M2C_P, FMC2_DP.DP3_C2M_N, FMC2_DP.DP3_C2M_P, FMC2_DP.DP3_M2C_N, FMC2_DP.DP3_M2C_P, FMC2_DP.DP4_C2M_N, FMC2_DP.DP4_C2M_P, FMC2_DP.DP4_M2C_N, FMC2_DP.DP4_M2C_P, FMC2_DP.DP5_C2M_N, FMC2_DP.DP5_C2M_P, FMC2_DP.DP5_M2C_N, FMC2_DP.DP5_M2C_P, FMC2_DP.DP6_C2M_N, FMC2_DP.DP6_C2M_P, FMC2_DP.DP6_M2C_N, FMC2_DP.DP6_M2C_P, FMC2_DP.DP7_C2M_N, FMC2_DP.DP7_C2M_P, FMC2_DP.DP7_M2C_N, FMC2_DP.DP7_M2C_P, FMC2_GBT_CLK.GBTCLK0_M2C_N, FMC2_GBT_CLK.GBTCLK0_M2C_P, FMC2_GBT_CLK.GBTCLK1_M2C_N, FMC2_GBT_CLK.GBTCLK1_M2C_P, FMC2_GBTCLKC0_M2C_N, FMC2_GBTCLKC0_M2C_P, GTH_Rx0_N, GTH_Rx0_P, GTH_Rx1_N, GTH_Rx1_P, GTH_Rx2_N, GTH_Rx2_P, GTH_Rx3_N, GTH_Rx3_P, GTH_Rx4_N, GTH_Rx4_P, GTH_Rx5_N, GTH_Rx5_P, GTH_Rx6_N, GTH_Rx6_P, GTH_Rx7_N, GTH_Rx7_P, GTH_Tx0_N, GTH_Tx0_P, GTH_Tx1_N, GTH_Tx1_P, GTH_Tx2_N, GTH_Tx2_P, GTH_Tx3_N, GTH_Tx3_P, GTH_Tx4_N, GTH_Tx4_P, GTH_Tx5_N, GTH_Tx5_P, GTH_Tx6_N, GTH_Tx6_P, GTH_Tx7_N, GTH_Tx7_P, GTP0RXC_N, GTP0RXC_P, GTP0TXC_N, GTP0TXC_P, GTP1RXC_N, GTP1RXC_P, GTP1TXC_N, GTP1TXC_P, GTP2RXC_N, GTP2RXC_P, GTP2TXC_N, GTP2TXC_P, GTP3RXC_N, GTP3RXC_P, GTP3TXC_N, GTP3TXC_P, GTP4RXC_N, GTP4RXC_P, GTP4TXC_N, GTP4TXC_P, GTP5RXC_N, GTP5RXC_P, GTP5TXC_N, GTP5TXC_P, GTP6RXC_N, GTP6RXC_P, GTP6TXC_N, GTP6TXC_P, GTP7RXC_N, GTP7RXC_P, GTP7TXC_N, GTP7TXC_P, GTP8RXC_N, GTP8RXC_P, GTP8TXC_N, GTP8TXC_P, GTP9RXC_N, GTP9RXC_P, GTP9TXC_N, GTP9TXC_P, GTP10RXC_N, GTP10RXC_P, GTP10TXC_N, GTP10TXC_P, GTP11RXC_N, GTP11RXC_P, GTP11TXC_N, GTP11TXC_P, GTP12RXC_N, GTP12RXC_P, GTP12TXC_N, GTP12TXC_P, GTP13RXC_N, GTP13RXC_P, GTP13TXC_N, GTP13TXC_P, GTP14RXC_N, GTP14RXC_P, GTP14TXC_N, GTP14TXC_P, GTP15RXC_N, GTP15RXC_P, GTP15TXC_N, GTP15TXC_P, GTP_CLKC1_IN_N, GTP_CLKC1_IN_P, GTX_CLK_CUST1C_N, GTX_CLK_CUST1C_P, GTX_CLK_CUST2C_N, GTX_CLK_CUST2C_P, GTX_CLK_CUST4_N, GTX_CLK_CUST4_P, GTX_CLOCKS.GTX_CLK_CUST1_N, GTX_CLOCKS.GTX_CLK_CUST1_P, GTX_CLOCKS.GTX_CLK_CUST2_N, GTX_CLOCKS.GTX_CLK_CUST2_P, GTX_CLOCKS.GTX_CLK_CUST4_N, GTX_CLOCKS.GTX_CLK_CUST4_P, MGT.REF_CLK0_225_N, MGT.REF_CLK0_225_P, MGT.REF_CLK0_226_N, MGT.REF_CLK0_226_P, MGT.REF_CLK0_227_N, MGT.REF_CLK0_227_P, MGT.REF_CLK0_228_N, MGT.REF_CLK0_228_P, MGT.REFCLK0_226_N, MGT.REFCLK0_226_P, MGT.REFCLK0_227_N, MGT.REFCLK0_227_P, MGT.REFCLK0_228_N, MGT.REFCLK0_228_P, RTM_GTP.GTP0-3_CLK_IN_N, RTM_GTP.GTP0-3_CLK_IN_P, RTM_GTP.GTP0-3_CLK_OUT_N, RTM_GTP.GTP0-3_CLK_OUT_P, RTM_GTP.GTP0RX_N, RTM_GTP.GTP0RX_P, RTM_GTP.GTP0TX_N, RTM_GTP.GTP0TX_P, RTM_GTP.GTP1RX_N, RTM_GTP.GTP1RX_P, RTM_GTP.GTP1TX_N, RTM_GTP.GTP1TX_P, RTM_GTP.GTP2RX_N, RTM_GTP.GTP2RX_P, RTM_GTP.GTP2TX_N, RTM_GTP.GTP2TX_P, RTM_GTP.GTP3RX_N, RTM_GTP.GTP3RX_P, RTM_GTP.GTP3TX_N, RTM_GTP.GTP3TX_P, RTM_GTP.GTP4-7_CLK_IN_N, RTM_GTP.GTP4-7_CLK_IN_P, RTM_GTP.GTP4-7_CLK_OUT_N, RTM_GTP.GTP4-7_CLK_OUT_P, RTM_GTP.GTP4RX_N, RTM_GTP.GTP4RX_P, RTM_GTP.GTP4TX_N, RTM_GTP.GTP4TX_P, RTM_GTP.GTP5RX_N, RTM_GTP.GTP5RX_P, RTM_GTP.GTP5TX_N, RTM_GTP.GTP5TX_P, RTM_GTP.GTP6RX_N, RTM_GTP.GTP6RX_P, RTM_GTP.GTP6TX_N, RTM_GTP.GTP6TX_P, RTM_GTP.GTP7RX_N, RTM_GTP.GTP7RX_P, RTM_GTP.GTP7TX_N, RTM_GTP.GTP7TX_P, RTM_GTP.GTP8-11_CLK_IN_N, RTM_GTP.GTP8-11_CLK_IN_P, RTM_GTP.GTP8-11_CLK_OUT_N, RTM_GTP.GTP8-11_CLK_OUT_P, RTM_GTP.GTP8RX_N, RTM_GTP.GTP8RX_P, RTM_GTP.GTP8TX_N, RTM_GTP.GTP8TX_P, RTM_GTP.GTP9RX_N, RTM_GTP.GTP9RX_P, RTM_GTP.GTP9TX_N, RTM_GTP.GTP9TX_P, RTM_GTP.GTP10RX_N, RTM_GTP.GTP10RX_P, RTM_GTP.GTP10TX_N, RTM_GTP.GTP10TX_P, RTM_GTP.GTP11RX_N, RTM_GTP.GTP11RX_P, RTM_GTP.GTP11TX_N, RTM_GTP.GTP11TX_P, RTM_GTP.GTP12-15_CLK_IN_N, RTM_GTP.GTP12-15_CLK_IN_P, RTM_GTP.GTP12-15_CLK_OUT_N, RTM_GTP.GTP12-15_CLK_OUT_P, RTM_GTP.GTP12RX_N, RTM_GTP.GTP12RX_P, RTM_GTP.GTP12TX_N, RTM_GTP.GTP12TX_P, RTM_GTP.GTP13RX_N, RTM_GTP.GTP13RX_P, RTM_GTP.GTP13TX_N, RTM_GTP.GTP13TX_P, RTM_GTP.GTP14RX_N, RTM_GTP.GTP14RX_P, RTM_GTP.GTP14TX_N, RTM_GTP.GTP14TX_P, RTM_GTP.GTP15RX_N, RTM_GTP.GTP15RX_P, RTM_GTP.GTP15TX_N, RTM_GTP.GTP15TX_P
net class D100: (no net found under the mark), FAT_PIPE1.RX4_N, FAT_PIPE1.RX4_P, FAT_PIPE1.RX5_N, FAT_PIPE1.RX5_P, FAT_PIPE1.RX6_N, FAT_PIPE1.RX6_P, FAT_PIPE1.RX7_N, FAT_PIPE1.RX7_P, FAT_PIPE1.TX4_N, FAT_PIPE1.TX4_P, FAT_PIPE1.TX5_N, FAT_PIPE1.TX5_P, FAT_PIPE1.TX6_N, FAT_PIPE1.TX6_P, FAT_PIPE1.TX7_N, FAT_PIPE1.TX7_P, FAT_PIPE2.RX8_N, FAT_PIPE2.RX8_P, FAT_PIPE2.RX9_N, FAT_PIPE2.RX9_P, FAT_PIPE2.RX10_N, FAT_PIPE2.RX10_P, FAT_PIPE2.RX11_N, FAT_PIPE2.RX11_P, FAT_PIPE2.TX8_N, FAT_PIPE2.TX8_P, FAT_PIPE2.TX9_N, FAT_PIPE2.TX9_P, FAT_PIPE2.TX10_N, FAT_PIPE2.TX10_P, FAT_PIPE2.TX11_N, FAT_PIPE2.TX11_P, FCLKAC_N, FCLKAC_P, FMC1_GBTCLKC0_M2C_N, FMC1_GBTCLKC0_M2C_P, FMC1_GBTCLKC1_M2C_N, FMC1_GBTCLKC1_M2C_P, FMC2_GBTCLKC0_M2C_N, FMC2_GBTCLKC0_M2C_P, GTH_Rx0_N, GTH_Rx0_P, GTH_Rx1_N, GTH_Rx1_P, GTH_Rx2_N, GTH_Rx2_P, GTH_Rx3_N, GTH_Rx3_P, GTH_Rx4_N, GTH_Rx4_P, GTH_Rx5_N, GTH_Rx5_P, GTH_Rx6_N, GTH_Rx6_P, GTH_Rx7_N, GTH_Rx7_P, GTH_Tx0_N, GTH_Tx0_P, GTH_Tx1_N, GTH_Tx1_P, GTH_Tx2_N, GTH_Tx2_P, GTH_Tx3_N, GTH_Tx3_P, GTH_Tx4_N, GTH_Tx4_P, GTH_Tx5_N, GTH_Tx5_P, GTH_Tx6_N, GTH_Tx6_P, GTH_Tx7_N, GTH_Tx7_P, GTP0RXC_N, GTP0RXC_P, GTP0TXC_N, GTP0TXC_P, GTP1RXC_N, GTP1RXC_P, GTP1TXC_N, GTP1TXC_P, GTP2RXC_N, GTP2RXC_P, GTP2TXC_N, GTP2TXC_P, GTP3RXC_N, GTP3RXC_P, GTP3TXC_N, GTP3TXC_P, GTP4RXC_N, GTP4RXC_P, GTP4TXC_N, GTP4TXC_P, GTP5RXC_N, GTP5RXC_P, GTP5TXC_N, GTP5TXC_P, GTP6RXC_N, GTP6RXC_P, GTP6TXC_N, GTP6TXC_P, GTP7RXC_N, GTP7RXC_P, GTP7TXC_N, GTP7TXC_P, GTP8RXC_N, GTP8RXC_P, GTP8TXC_N, GTP8TXC_P, GTP9RXC_N, GTP9RXC_P, GTP9TXC_N, GTP9TXC_P, GTP10RXC_N, GTP10RXC_P, GTP10TXC_N, GTP10TXC_P, GTP11RXC_N, GTP11RXC_P, GTP11TXC_N, GTP11TXC_P, GTP12RXC_N, GTP12RXC_P, GTP12TXC_N, GTP12TXC_P, GTP13RXC_N, GTP13RXC_P, GTP13TXC_N, GTP13TXC_P, GTP14RXC_N, GTP14RXC_P, GTP14TXC_N, GTP14TXC_P, GTP15RXC_N, GTP15RXC_P, GTP15TXC_N, GTP15TXC_P, GTP_CLKC1_IN_N, GTP_CLKC1_IN_P, GTX_CLK_CUST1C_N, GTX_CLK_CUST1C_P, GTX_CLK_CUST2C_N, GTX_CLK_CUST2C_P, GTX_CLK_CUST4_N, GTX_CLK_CUST4_P, GTX_CLOCKS.GTX_CLK_CUST2_N, GTX_CLOCKS.GTX_CLK_CUST2_P, GTX_CLOCKS.GTX_CLK_CUST4_N, GTX_CLOCKS.GTX_CLK_CUST4_P, MGT.REF_CLK0_225_N, MGT.REF_CLK0_225_P, MGT.REF_CLK0_226_N, MGT.REF_CLK0_226_P, MGT.REF_CLK0_227_N, MGT.REF_CLK0_227_P, MGT.REF_CLK0_228_N, MGT.REF_CLK0_228_P, MGT.REFCLK0_226_N, MGT.REFCLK0_226_P, MGT.REFCLK0_228_N, MGT.REFCLK0_228_P

## Notes on the sheet
- not used
- GTX
- Project/Equipment
- Document
- AMC FMC Carrier Board
- Designer
- Drawn by
- Check.by
- P.Kulik
- 29.07.2020
- Copyright WUT ISE 2020.
  This documentation describes Open Hardware and is licensed under the CERN OHL v.1.2. You may redistribute and modify this documentation under the terms of the CERN OHL v.1.2. (http://ohwr.org/CERNOHL). This documentation is distributed WITHOUT ANY EXPRESS OR IMPLIED WARRANTY, INCLUDING OF MERCHANTABILITY, SATISFACTORY QUALITY AND FITNESS FOR A PARTICULAR PURPOSE. Please see the CERN OHL v.1.2 for applicable conditions.
- Contact
- File
- Last Mod.
- Print Date
- F.Świtakowski
- Sheet
- Size
- A3
- of
- v2
- Rev
- (in symbol XCZU7CG-1FFVF1517E, part K) BANK 223
- (in symbol XCZU7CG-1FFVF1517E, part L) BANK 224
- (in symbol XCZU7CG-1FFVF1517E, part M) BANK 225
- (in symbol XCZU7CG-1FFVF1517E, part N) BANK 226
- (in symbol XCZU7CG-1FFVF1517E, part O) BANK 227
- (in symbol XCZU7CG-1FFVF1517E, part P) BANK 228

## Library data of the parts
C176-C179 C181 C215 C264-C273 C579-C596 C599-C662 C665-C730 C739-C742 C744 C745 C925-C948 C1004-C1007 = CC0201_100NF_6.3V_10%_X5R: Non-polarised capacitor; Manufacturer: GENERIC; Part Description: SMD Multilayer Chip Ceramic Capacitor; Manufacturer1 Part Number: 02016D104KAT2A; Tolerance: ±10%; Voltage: 6.3V; TC: X5R; Manufacturer Part Number: CC0201_100NF_6.3V_10%_X5R; Part Number: CC0201_100NF_6.3V_10%_X5R; Value: 100nF; Component Kind: Standard; Component Type: Standard; Pin Count: 2; Status: Not Recommended; Case: 0201; Mounted: Yes; Socket: No; SMD: Yes; Sense: No; Manufacturer1 Example: AVX; Manufacturer1 ComponentHeight: 0.33mm; HelpURL: \\cern.ch\dfs\Applications\Altium\Datasheets\CC0201_X5R_AVX.pdf; Author: CERN DEM JLC; CreateDate: 03/12/2007; LatestRevisionDate: 03/12/2007
C549 C559 C597 C598 C663 C664 C737 C738 C760 C761 C910-C912 C990-C998 = CC0201_100NF_6.3V_10%_X5R: Non-polarised capacitor; Part Description: SMD Multilayer Chip Ceramic Capacitor; Manufacturer: GENERIC; Manufacturer1 Part Number: 02016D104KAT2A; Voltage: 6.3V; TC: X5R; Tolerance: ±10%; Part Number: CC0201_100NF_6.3V_10%_X5R; Component Kind: Standard; Component Type: Standard; Pin Count: 2; Value: 100nF; Status: Not Recommended; Manufacturer Part Number: CC0201_100NF_6.3V_10%_X5R; Case: 0201; Mounted: Yes; Socket: No; SMD: Yes; Sense: No; Manufacturer1 Example: AVX; Manufacturer1 ComponentHeight: 0.33mm; HelpURL: \\cern.ch\dfs\Applications\Altium\Datasheets\CC0201_X5R_AVX.pdf; Author: CERN DEM JLC; CreateDate: 03.12.2007; LatestRevisionDate: 03.12.2007
IC34 = XCZU7CG-1FFVF1517E: Zynq UltraScale+ RFSoC, Quad-Core ARM® Cortex™-A53 MPCore™ up to 1.5GHz, 214 PS I/O, 416 HP I/O, 48 HD I/O, 1517-Pin BGA; Part Description: Zynq UltraScale+ MPSoC, Quad-Core ARM® Cortex™-A53 MPCore™ up to 1.5GHz, 214 PS I/O, 416 HP I/O, 48 HD I/O, 1517-Pin BGA; Manufacturer: XILINX; PressFit: No; Bonding: No; Part Number: XCZU7CG-1FFVF1517E; Component Kind: Standard; Component Type: Standard; Device: XCZU7CG-1FFVF1517E; PackageDescription: BGA, 1.00mm Pitch, Square; 1517 Pin, 39 Columns X 39 Rows, Body 40.00mm X 40.00mm X 3.51mm H, IPC Medium Density; Manufacturer Part Number: XCZU7CG-1FFVF1517E; Pin Count: 1517; Case: BGA1517; Mounted: Yes; Socket: No; SMD: Yes; Sense: No; ComponentHeight: 3.51mm; HelpURL: \\cern.ch\dfs\Applications\Altium\Datasheets\XCZU7CG-1FFVF1517E.pdf; ComponentLink1URL: \\cern.ch\dfs\Applications\Altium\Datasheets\XCZU7CG-1FFVF1517E_Package-Pinout.pdf; ComponentLink1Description: Package/Pinout; ComponentLink2URL: \\cern.ch\dfs\Applications\Altium\Datasheets\XCZU7CG-1FFVF1517E_Pinout.pdf; ComponentLink2Description: Pinout; Author: CERN DEM BC; CreateDate: 10.07.2019; LatestRevisionDate: 10.07.2019